# EAGLE board BalanduinoPCB-V1.1 (EAGLE 6.2) (continued)
## Tracks (layer width: path | path; a pad name or v marks a point on that pad's centre or on a via) (continued)
  Top 0.813: C25.2 76.87,35.22 C20.- 76.71,31.41 R24.1 | C4.1 21.68,43.09 21.49,42.9
  Top 1.27: 41.15,56.41 IC8.1 46.25,56.41 47.75,57.91 54.36,57.91 | 41.15,56.41 40.79,56.41 40.79,57.76 40.51,58.04 40.39,58.17 | 54.36,57.91 57.66,57.91 58.67,57.91 59.94,56.64 | C7.2 54.36,57.91 | C8.- 29.11,38.51 28.96,38.35 29.01,38.3 v29.01,38.23 | 38.1,58.55 37.84,58.29 IC4.1 37.84,55.89 37.85,55.88 | C5.2 41.15,56.41
  Top 1.676: 11.05,32.38 10.74,32.08 8.46,32.08 5.11,28.73 MOTOR1.3 2.57,28.73 2.54,28.7 | v89.87,27.1 90.6,27.1 94.74,31.24 96.77,31.24
  Top 2.083: 36.5,58.55 38.1,58.55 40.72,58.55
  Bottom 2.083: 33.78,58.55 36.58,58.55
  other vias: 10.19,31.88 10.19,17.96 11.2,17.96 12.22,17.96 10.19,16.94 10.19,15.93 11.2,16.94 11.2,15.93 12.22,15.93 12.22,16.94 11.2,31.88 12.22,31.88 12.22,32.89 11.2,32.89 10.19,32.89 12.22,33.91 11.2,33.91 10.19,33.91 30.02,37.21 30.02,38.23 31.04,38.23 29.01,37.21 31.04,37.21 32.05,38.23 32.05,37.21 25.96,38.23 25.96,37.21 26.97,37.21 27.99,37.21 27.99,38.23 26.97,38.23 24.94,37.21 24.94,38.23 87.83,28.12 88.85,28.12 89.87,28.12 87.83,27.1 87.83,26.09 88.85,26.09 89.87,26.09 88.85,27.1 89.89,41.99 88.87,41.99 87.86,41.99 89.89,43 89.89,44.02 88.87,43 88.87,44.02 87.86,43 90.88,28.12 90.88,27.1 90.88,26.09 90.91,44.02 90.91,43 90.91,41.99 9.17,33.91 9.17,32.89 9.17,31.88 9.17,17.96 9.17,16.94 9.17,15.93 11.46,40.39 10.44,39.37 10.44,40.39 12.47,39.37 11.46,39.37 12.47,40.39 33.53,25.15 33.53,26.16 38.58,58.09 38.58,59.11 36.55,59.11 37.57,59.11 83.57,18.29 87.86,44.02 24.94,39.24 25.96,39.24 26.97,39.24 27.99,39.24 29.01,39.24 30.02,39.24 31.04,39.24 32.05,39.24 39.6,59.11 40.61,59.11 13.49,40.39 13.49,39.37 9.42,39.37 9.42,40.39 37.57,58.09 39.6,58.09
  pour Top (no thermals): 10.67,28.98 10.67,31.24 6.6,31.24 6.6,39.37 12.7,39.37 12.7,28.98 12.17,28.98 12.17,31.24 11.28,31.24 11.28,28.98
  pour Top (no thermals): 12.78,20.8 12.78,15.44 8.59,15.44 8.59,18.49 10.67,18.49 10.67,20.8 11.28,20.8 11.28,18.54 12.17,18.54 12.17,20.8
  pour Top (no thermals): 0.51,44.2 8.89,44.2 8.89,41.15 32.77,41.15 32.77,36.83 17.02,36.83 17.02,38.86 0.53,38.86
  pour Top (no thermals): 89.41,30.96 89.41,28.7 91.41,28.7 91.41,25.6 87.3,25.6 87.3,30.96 87.91,30.96 87.91,28.7 88.8,28.7 88.8,30.96
  pour Top (no thermals): 87.33,39.14 87.33,44.5 91.47,44.5 91.47,41.4 89.41,41.4 89.41,39.14 88.82,39.14 88.82,41.4 87.91,41.4 87.91,39.14
  pour Bottom (isolate 0.406, no thermals): 35.56,60 100,60 100,0 0,0 0,60 35.05,60 35.05,57.58 13.97,57.58 13.97,38.61 12.65,38.61 12.65,31.37 7.72,31.34 7.72,18.49 12.65,18.49 12.7,2.51 87.22,2.51 87.45,28.7 92.46,28.7 92.46,41.4 87.43,41.4 87.43,45.16 84.43,45.16 84.43,57.58 35.56,57.58
  pour Bottom (isolate 0.406, no thermals): 32,52.07 79.25,52.07 79.25,30.86 84.2,30.86 84.2,24.97 87.63,24.97 87.63,2.29 12.45,2.29 12.45,14.78 15.93,14.78 15.93,20.83 21.34,20.83 21.34,36.83 24.64,40.13 30.99,40.13 32,41.15
  pour Top (no thermals): 17.02,40.64 17.02,43.94 22.1,43.94 22.1,40.64
GPIN0  (via drill 0.4)
  Top 0.254: v13.46,5.59 13.46,4.06 15.75,1.78 44.2,1.78 44.7,2.29 44.7,4.19 40.26,8.64 38.61,8.64 37.59,7.62 34.04,7.62 33.55,8.11 IC2.26 | R34.1 7.58,12.41 OL.1 7.11,12.45 7.11,12.7 4.68,15.13 U1.3
  Bottom 0.254: v13.46,5.59 12.7,5.59 7.37,10.92 OL.1
GPIN1
  Top 0.254: IC2.27 34.05,8.37 34.29,8.13 37.39,8.13 38.4,9.14 40.46,9.14 42.24,7.37 44.02,7.37 45.8,5.59 49.28,5.59 GI1.1
GPIN2
  Top 0.254: IC2.28 34.55,8.89 34.8,8.64 37.16,8.64 38.18,9.65 40.64,9.65 41.4,8.89 44.45,8.89 GI2.1
GPIN3
  Top 0.254: IC2.29 35.05,9.4 35.31,9.14 36.98,9.14 38,10.16 40.89,10.16 41.66,9.4 46.48,9.4 GI3.1
GPIN4
  Top 0.254: IC2.30 35.55,9.92 35.81,9.65 36.83,9.65 37.85,10.67 41.15,10.67 41.91,9.91 52.58,9.91 GI4.1
GPIN5  (via drill 0.4)  (1 unrouted)
  Top 0.254: IC2.31 36.05,12.21 35.92,12.34 v35.53,12.34
  Bottom 0.254: GI5.1 39.37,8.51 35.56,12.32
GPIN6
  Top 0.254: IC2.32 36.55,11.15 36.58,11.18 42.16,11.18 42.67,11.68 42.67,14.99 43.94,16.26 GI6.1
GPIN7
  Top 0.254: IC2.1 38.58,12.22 39.12,11.68 41.91,11.68 42.16,11.94 42.16,14.99 41.15,16 GI7.1
GPOUT0  (via drill 0.4)
  Top 0.254: 4.65,18.26 4.65,18.64 3.73,19.56 1.52,19.56 1.02,19.05 1.02,9.91 1.52,9.4 6.86,9.4 14.99,1.27 44.45,1.27 45.21,2.03 45.21,4.83 v43.43,6.6 | EN.1 6.86,15.75 4.65,17.96 4.65,18.26 | 4.57,18.03 4.69,18.15 U1.4 4.65,18.26 | 37.85,13.72 IC2.4 39.55,13.72 v39.88,14.05
  Bottom 0.254: v43.43,6.6 43.43,7.65 39.88,11.2 v39.88,14.05
GPOUT1
  Top 0.254: IC2.5 38.86,14.22 39.62,14.99 39.62,17.02 GO1.1
GPOUT2  (via drill 0.4)
  Top 0.254: IC2.6 36.82,14.72 36.19,14.1 34.52,14.1 v34.47,14.15
  Bottom 0.254: GO2.1 29.21,5.84 29.97,6.6 31.24,6.6 32,7.37 32,9.14 34.54,11.68 34.54,14.07 v34.47,14.15
GPOUT3  (via drill 0.4)
  Top 0.254: IC2.7 36.56,15.22 36.22,14.88 33.78,14.88 33.78,14.86 v33.6,14.68
  Bottom 0.254: GO3.1 30.73,8.76 34.04,12.06 34.04,12.95 33.27,13.72 33.27,14.35 v33.6,14.68
GPOUT4  (via drill 0.4)
  Top 0.254: IC2.8 37.37,15.72 37.34,15.75 37.34,18.8 37.85,19.3 39.62,19.3 v39.88,19.05 | GO4.1 42.27,24.49 v39.88,22.1
  Bottom 0.254: v39.88,19.05 v39.88,22.1
GPOUT5  (via drill 0.4)
  Top 0.254: IC2.9 36.55,15.85 36.32,15.62 35.81,15.62 v35.81,15.65
  Bottom 0.254: 35.81,15.62 v35.81,15.65 35.81,16.51 35.48,16.84 33.35,16.84 32.26,15.75 30.73,15.75 29.72,16.76 29.72,21.08 31.5,22.86 31.5,23.62 30.99,24.13 GO5.1
GPOUT6  (via drill 0.4)  (1 unrouted)
  Top 0.254: v32.26,18.8 30.4,18.8 29.64,18.03 26.92,18.03 | IC2.10 36.05,18.01 36.58,18.54 v36.58,18.49
  Bottom 0.254: v36.58,18.49 36.53,18.49 36.07,18.03 33.02,18.03 v32.26,18.8
GPOUT7  (via drill 0.4)
  Top 0.254: IC2.11 35.55,18.78 35.81,19.05 35.79,19.08 v35.79,19.13
  Bottom 0.254: v35.79,19.13 35.74,19.13 34.8,20.07 GO7.1
GPX
  Top 0.254: IC2.17 31.7,16.82 GPX.1
INT2  (via drill 0.4)
  Top 0.254: v46.99,22.86 46.99,22.1 47.61,21.48 IC1.42
  Bottom 0.254: v46.99,22.86 42.93,22.86 41.4,24.38 36.83,24.38 35.31,25.91 35.31,30.73 36.83,32.26 41.15,32.26 43.43,34.54 44.7,34.54 47.24,37.08 47.24,41.15 47.75,41.66 54.1,41.66 56.13,43.69 SV2.6
LED  (via drill 0.4)
  Top 0.254: v56.39,26.16 56.39,22.86 v54.86,21.34 | v46.99,19.56 47.24,19.81 48.51,19.81 48.56,19.85 IC1.44 | v67.14,49.02 R10.2
  Bottom 0.254: v56.39,26.16 59.69,29.46 59.69,30.73 62.48,33.53 62.48,41.66 62.74,41.91 64.01,41.91 66.29,44.2 SV2.10 67.14,45.55 v67.14,49.02 | v54.86,21.34 49.53,21.34 47.75,19.56 v46.99,19.56
M1A  (via drill 0.4)  (1 unrouted)
  Top 0.254: v56.64,27.94 56.64,29.56 IC1.25 | v40.64,26.16 40.64,25.15 37.34,21.84 29.21,21.84 27.18,19.81 26.16,19.81 25.15,18.8 25.15,16.87 24.64,16.36 21.62,16.36 20.07,17.91 19.13,17.91 18.44,17.22 18.44,17.12 17.58,16.26 R20.2 16.93,16.17 16.26,15.49 R41.2 | M1A.1 8.13,17.02 8.13,15.24 8.38,14.99 16,14.99 16.51,15.49
  Bottom 0.254: v40.64,26.16 40.64,28.19 41.91,29.46 55.12,29.46 v56.64,27.94
M1B  (via drill 0.4)
  Top 0.254: R21.2 16.76,34.29 17.78,35.31 18.8,35.31 | 18.8,35.31 28.19,35.31 28.7,34.8 32.26,34.8 33.78,36.32 37.34,36.32 42.93,30.73 v45.97,30.73 | IC1.26 55.88,29.6 55.88,27.43 55.37,26.92 54.36,26.92 54.1,26.67 51.56,26.67 49.28,28.96 v49.28,30.73 | v45.97,30.73 46.08,30.73 | M1B.1 18.8,35.31 | R40.2 46.05,30.81 v45.97,30.73
  Bottom 0.254: v49.28,30.73 v45.97,30.73
M1CS  (via drill 0.4)
  Top 0.254: R18.1 21.68,30.06 23.37,31.75 | 23.37,31.75 24.55,31.75 C14.1 | v22.86,32.26 23.37,31.75
  Bottom 0.254: SV4.1 25.65,27.69 22.86,30.48 v22.86,32.26
M1CS_DIS
  Top 0.254: SV4.2 28.45,33.02 27.18,34.29 22.26,34.29 R14.1
M1EN  (via drill 0.4)
  Top 0.254: v58.42,31.24 58.42,29.74 IC1.23 | 24.89,19.81 25.4,20.32 26.92,20.32 28.96,22.35 37.08,22.35 39.88,25.15 39.88,26.92 v39.9,26.92 | 24.89,19.81 24.38,19.3 24.13,19.3 23.88,19.05 | 23.62,18.99 23.62,19.05 23.88,19.05 | R16.2 23.9,19.02 23.88,19.05 | v25.02,19.81 24.89,19.81
  Bottom 0.254: v39.9,26.92 39.9,28.22 41.66,29.97 57.15,29.97 v58.42,31.24 | M1EN.1 25.78,20.57 v25.02,19.81
M2A  (via drill 0.4)
  Top 0.203: R27.2 83.31,43.94
  Top 0.254: v50.55,23.11 48.52,23.11 | 48.51,23.11 48.52,23.11 | 48.52,23.11 IC1.40 | v70.36,26.42 71.37,25.4 73.15,25.4 73.66,25.91 73.66,44.2 75.95,46.48 83.31,46.48 | 83.31,46.48 R27.2 | 83.31,46.48 86.87,46.48 87.54,45.81 R39.2 87.54,45.89 89.15,47.5 89.15,47.75 M2A.1
  Bottom 0.254: v50.55,23.11 51.05,22.61 70.36,22.61 71.37,23.62 71.37,25.65 70.61,26.42 v70.36,26.42
M2B  (via drill 0.4)
  Top 0.203: 77.22,21.34 80.52,21.34 82.55,23.37 83.57,23.37 | 83.4,23.62 R38.2 | R38.2 83.48,23.46 | 83.06,24.89 R28.2 83.15,24.8 83.31,24.64 83.31,23.62 83.57,23.37 | R38.2 83.57,23.37
  Top 0.254: 77.22,21.34 v75.18,23.37 | IC1.41 50.11,22.28 50.29,22.1 v50.29,22.07 | 83.57,23.37 84.58,23.37 M2B.1
  Bottom 0.254: v75.18,23.37 73.66,23.37 72.39,22.1 50.29,22.1 v50.29,22.07
M2CS
  Top 0.254: C27.1 77.22,28.28 R25.1 77.38,27.01 SV5.1
M2CS_DIS
  Top 0.254: SV5.2 79.25,23.37 80.77,24.89 R29.1
M2EN  (via drill 0.4)
  Top 0.254: R23.2 75.18,42.93 74.68,42.42 74.68,32 v75.18,31.5 | IC1.24 57.56,31.9 57.91,32.26 64.01,32.26 v66.8,29.46
  Bottom 0.254: v66.8,29.46 72.14,29.46 | 72.14,29.46 73.15,29.46 v75.18,31.5 | M2EN.1 72.39,29.72 72.14,29.46
MAX_INT  (via drill 0.4)  (1 unrouted)
  Top 0.254: IC1.21 61.11,27.08 61.47,27.43 64.01,27.43 v64.26,27.18 | 28.96,17.27 R5.1 28.96,17.02 29.21,17.02 29.72,16.51 29.72,16 30.5,15.22 IC2.18 32.75,15.22 33.27,15.75
  Bottom 0.254: v64.26,27.18 64.52,27.43 79.25,27.43 80.52,26.16 80.52,8.89 77.22,5.59 43.31,5.59 42.16,6.73 42.16,8.2 35.05,15.32 35.05,16 34.67,16.38 33.66,16.38 33.27,16 33.27,15.7 v33.22,15.65
MAX_SS  (via drill 0.4)
  Top 0.254: v64.26,28.45 61.21,28.45 | 61.21,28.45 60.71,27.94 60.2,27.94 60.16,27.9 IC1.22 | 61.21,28.45 61.21,29.72 R37.2 | IC2.14 34.05,15.81 v34.24,15.62
  Bottom 0.254: v64.26,28.45 79.76,28.45 81.03,27.18 81.03,8.64 77.47,5.08 42.67,5.08 41.66,6.1 41.66,8 34.24,15.42 v34.24,15.62
MISO
  Top 0.254: IC2.15 33.55,19.83 34.54,20.83 43.43,20.83 48.51,15.75 48.51,14.22 X3.1 51.16,15.85 IC1.2
MOSI  (via drill 0.4)
  Top 0.254: IC1.1 50.36,16.57 v49.4,15.62 43.69,21.34 34.29,21.34 33.05,20.09 IC2.16
  Bottom 0.254: X3.4 47.5,12.45 50.29,12.45 51.05,13.21 51.05,13.97 v49.4,15.62
MOUT1A  (via drill 0.4)
  Top 0.254: IC5.2 10.24,19.96 10.24,22.86 | 10.24,23.01 11.82,23.01 IC5.S2 11.82,22.86 | IC5.8 13.21,22.86
  Top 1.676: 10.24,23.65 10.24,22.86 | 2.54,23.62 2.54,23.65 MOTOR1.1 9.88,23.65 9.91,23.62
  other vias: 13.06,23.9 13.06,22.89 13.06,21.87 12.04,21.87 11.02,21.87 10.01,21.87 8.99,21.87 8.99,22.89 8.99,23.9 10.01,23.9 11.02,23.9 12.04,23.9 12.04,22.89 11.02,22.89 10.01,22.89 14.76,17.96 13.74,17.96 14.76,16.94 14.76,15.93 13.74,15.93 13.74,16.94
  pour Top (no thermals): 8.38,24.49 13.54,24.49 13.54,21.34 8.38,21.34
  pour Bottom (no thermals): 8.38,24.49 13.54,24.49 13.54,21.34 8.38,21.34
  pour Top (no thermals): 15.27,20.8 15.27,15.44 13.18,15.44 13.18,20.8 13.28,20.8 13.28,18.8 14.17,18.8 14.17,20.8
  pour Bottom (no thermals): 13.28,19.1 13.28,15.44 15.27,15.47 15.27,20.83 13.56,20.8 13.56,21.84 8.41,21.84 8.41,19.1
MOUT1B  (via drill 0.4)
  Top 0.254: IC5.29 13.23,29.82 13.23,26.42 | 12.19,26.42 11.82,26.42 IC5.S3 11.82,27.1 | IC5.35 10.24,29.82 10.24,27.1
  Top 1.676: 10.24,26.16 10.24,27.1 | 2.54,26.16 2.54,26.19 MOTOR1.2 9.62,26.19 9.65,26.16
  other vias: 13.06,25.86 13.06,26.87 13.06,27.89 12.04,27.89 11.02,27.89 10.01,27.89 8.99,27.89 8.99,26.87 8.99,25.86 10.01,25.86 10.01,26.87 11.02,26.87 12.04,26.87 12.04,25.86 11.02,25.86 13.69,33.91 14.71,33.91 14.71,32.89 14.71,31.88 13.69,31.88 13.69,32.89
  pour Top (no thermals): 8.38,28.45 13.54,28.45 13.54,25.3 8.38,25.3
  pour Bottom (no thermals): 8.38,28.45 13.54,28.45 13.54,25.3 8.38,25.3
  pour Top (no thermals): 13.18,28.98 13.18,34.47 15.27,34.47 15.27,28.98 14.17,28.98 14.17,30.99 13.28,30.99 13.28,28.98
  pour Bottom (no thermals): 13.28,30.68 13.28,34.47 15.09,34.47 15.09,28.98 13.56,28.98 13.56,27.94 8.41,27.94 8.41,30.68
MOUT2A  (via drill 0.4)
  Top 0.254: IC6.8 86.87,39.98 86.87,36.58 88.39,36.58 88.39,36.83 88.33,36.77 88.33,36.7 | IC6.2 89.86,36.77 89.79,36.7 88.33,36.7 | 88.33,36.7 IC6.S2
  Top 1.676: 89.86,36.77 89.86,36.35 MOTOR2.1 97.54,36.35 97.54,36.32
  other vias: 87.02,36.04 87.02,37.06 88.04,36.04 89.05,36.04 90.07,36.04 91.08,36.04 87.02,38.07 88.04,38.07 89.05,38.07 90.07,38.07 91.08,38.07 91.08,37.06 90.07,37.06 89.05,37.06 88.04,37.06 85.29,41.83 86.31,41.83 86.31,42.85 86.31,43.87 85.29,43.87 85.29,42.85
  pour Top (no thermals): 86.51,38.61 91.67,38.61 91.67,35.46 86.51,35.46
  pour Bottom (no thermals): 86.51,38.61 91.67,38.61 91.67,35.46 86.51,35.46
  pour Top (no thermals): 84.81,39.24 84.81,44.5 86.89,44.5 86.89,39.14 86.82,39.14 86.82,41.15 85.9,41.15 85.9,39.24
  pour Bottom (no thermals): 86.82,40.72 86.82,44.5 84.81,44.5 84.81,39.24 86.51,39.24 86.51,35.56 91.67,35.56 91.67,40.72
MOUT2B  (via drill 0.4)
  Top 0.254: IC6.29 86.86,33.26 | 87.12,33.53 88.21,33.53 IC6.S3 88.31,33.53 89.66,33.53 89.86,33.33 IC6.35
  Top 1.676: 89.86,33.33 89.86,33.81 MOTOR2.2 97.54,33.81 97.54,33.78
  other vias: 87.02,34.09 88.04,34.09 89.05,34.09 90.07,34.09 91.08,34.09 87.02,33.07 87.02,32.05 88.04,32.05 89.05,32.05 90.07,32.05 91.08,32.05 91.08,33.07 90.07,33.07 89.05,33.07 88.04,33.07 86.33,28.17 85.32,28.17 85.32,27.15 85.32,26.14 86.33,26.14 86.33,27.15
  pour Top (no thermals): 86.51,34.65 91.67,34.65 91.67,31.5 86.51,31.5
  pour Bottom (no thermals): 86.51,34.65 91.67,34.65 91.67,31.5 86.51,31.5
  pour Top (no thermals): 86.92,30.96 86.92,25.6 84.81,25.6 84.81,30.86 85.9,30.86 85.9,28.85 86.82,28.85 86.82,30.96
  pour Bottom (no thermals): 86.79,29.51 86.79,25.6 84.81,25.6 84.81,30.86 86.51,30.86 86.51,34.54 91.67,34.54 91.67,29.51
N$1
  Top 0.254: C3.2 61.98,10.92 SJ1.1
N$2
  Top 0.254: IC1.8 55.96,8.31 56.9,7.37 C2.1 56.81,3.47 56.64,3.3 Q1.1
N$3
  Top 0.254: IC1.7 55.16,7.42 C1.2 55.21,6.69 51.82,3.3 Q1.2
N$4
  Top 0.61: Q4.3 71.37,50.02 D2.A 72.92,51.56 77.22,51.56 77.88,50.9 BUZZER.-
N$5
  Top 0.254: R11.1 72.22,42 JP1.2
N$6
  Top 0.254: X4.2 81.79,15.75 73.66,15.75 73.15,16.26 70.87,16.26 70.61,16 R33.1
N$7
  Top 0.254: LED.A R10.1
N$9
  Top 0.254: R2.1 PWR.A
N$10
  Top 0.254: X4.3 82.63,12.87 80.26,15.24 72.22,15.24 R32.1
N$11
  Top 0.254: IC9.7 71.05,13.19 R33.2
N$12
  Top 0.61: 27.12,5.02 27.18,5.08 26.92,5.08 26.67,5.33 F1.2 27,5.2 SJ2.2
N$14  (1 unrouted)
  Top 0.254: 28.83,15.62 28.7,15.75 | IC2.20 30.74,14.22 29.72,15.24 29.3,15.24 R7.2
N$16
  Top 0.254: IC2.21 29.29,13.72 R6.2
N$17
  Top 0.254: X5.3 18.67,12.9 18.67,13.84 19.61,14.78 26.53,14.78 R6.1
N$18
  Top 0.254: R7.1 27.09,15.91 | R7.1 27.05,15.75 26.57,15.27 18.06,15.27 16.76,13.97 16.76,12.93 X5.2 | R7.1 27.18,15.75
N$19
  Top 0.254: IC2.25 33.05,7.85 34.04,6.86 | 34.04,6.86 34.04,5.84 36.58,3.3 Q2.2 | 34.04,6.86 34.29,6.6 C17.2
N$20
  Top 0.254: 31.34,12.22 31.35,12.22 IC2.24 32.33,12.22 32.35,12.21 32.35,6.86 C16.2 32.6,3.47 32.77,3.3 Q2.1
N$21  (1 unrouted)
  Top 0.254: IC3.12 36.67,27.85 37.59,26.92
N$22
  Top 0.254: IC3.20 34.56,33.78 | 34.56,33.78 34.56,33.93 | C22.1 34.56,33.78
N$23
  Top 0.254: IC3.10 34.06,26.99 C23.2
N$24
  Top 0.254: R23.1 R13.1 78.49,41.4 81.28,38.61 | IC6.21 82.86,31.27 82.63,31.5 82.04,31.5 81.28,32.26 81.28,38.61 | IC6.16 82.86,38.91 82.55,38.61 81.28,38.61
N$25
  Top 0.254: R25.2 79.08,30.23 | 79.08,30.23 R24.2 | IC6.19 79.19,30.12 79.08,30.23
N$26  (1 unrouted)
  Top 0.254: IC5.16 17.22,21.03 17.53,21.34 18.29,21.34 18.54,21.59 | 18.54,21.59 18.54,27.94 18.03,28.45 17.53,28.45 17.22,28.75 IC5.21 | 18.54,21.59 20.07,21.59 20.57,21.08 20.57,19.56 22.35,17.78 R15.1 23.39,17.77 R16.1 | 22.3,17.88 22,17.88 22.1,17.78
N$27
  Top 0.254: R11.2 70.52,46.57 70.36,46.74 70.37,46.75 Q4.1
N$29
  Top 0.254: IC5.19 18.94,29.82 20.32,28.45 21.84,28.45 | 21.84,28.45 24.13,28.45 R17.2 | R18.2 21.76,28.36 21.84,28.45
N$30
  Top 0.254: IC5.20 17.72,30.93 18.03,31.24 19.22,31.24 R12.1 20.57,30.9 R14.2 21.34,31.75
N$31
  Top 0.254: IC5.22 16.72,31.62 R21.1
N$32
  Top 0.254: IC5.15 16.72,18.94 17.42,18.24 17.53,18.24 | 17.53,18.24 17.66,18.24 | R20.1 17.58,18.19 17.53,18.24
N$33
  Top 0.254: IC5.17 17.72,18.96 17.93,18.74 18.73,18.74 18.73,19.53 R19.1
N$34
  Top 0.254: IC6.22 83.36,26.71 83.06,26.42 R28.1
N$35
  Top 0.254: IC6.15 83.36,42.29 R27.1
N$36
  Top 0.254: IC6.17 82.36,41.51 R26.1
N$37
  Top 0.254: IC6.20 82.36,28.09 R29.2 80.77,26.49 81.61,25.65 83.85,25.65 84.66,24.84 87.51,24.84 R22.1
N$40
  Top 0.61: F2.1 85.67,14.35 X4.1
N$41
  Top 0.254: IC9.15 71.7,6.87 R8.2
N$42
  Top 0.254: IC9.2 73.59,9.83 74.42,10.67 75.1,10.67 R9.2
N$43
  Top 0.254: IC9.6 71.7,13.19 R32.2
N$45
  Top 0.254: IC9.8 IC9.9 68.66,11.13 C30.2
N$48
  Top 0.254: RX.A 65.53,13.21 64.77,13.97 64.77,17.53 65.28,18.03 R3.1
N$49
  Top 0.254: R4.1 66.21,14.93 TX.A
PWM1A  (via drill 0.4)
  Top 0.254: v32.51,21.08 32.26,21.08 32,21.34 29.41,21.34 27.38,19.3 26.42,19.3 25.65,18.54 25.65,16.61 24.89,15.85 19.96,15.85 19.61,16.2 PWM1A.1 | IC1.14 61.33,21.48 62.99,19.81 v63.5,19.81 | 20.07,18.54 19.88,18.54 R19.2 20.36,18.76 20.83,18.29 v20.83,18.19
  Bottom 0.254: v32.51,21.08 36.07,21.08 37.34,19.81 37.34,16 38.35,14.99 40.13,14.99 41.15,13.97 41.15,11.18 42.93,9.4 61.21,9.4 63.5,11.68 v63.5,19.81 | PWM1A.1 19.61,16.97 v20.83,18.19
PWM1B  (via drill 0.4)
  Top 0.254: v74.17,22.48 74.17,43.94 75.18,44.96 PWM1B.1 80.52,44.96 81.53,43.94 R26.2 | IC1.13 58.83,20.68 v58.42,21.08
  Bottom 0.254: v58.42,21.08 58.93,21.59 73.28,21.59 v74.17,22.48
PWM2A  (via drill 0.4)
  Top 0.254: IC1.16 60.19,23.11 61.47,23.11 62.23,22.35 67.31,22.35 v68.33,23.37 | v68.33,25.91 69.09,26.67 69.09,40.89 67.56,42.42 62.48,42.42 61.21,43.69 SV2.8
  Bottom 0.254: v68.33,23.37 v68.33,25.91
PWM2B  (via drill 0.4)
  Top 0.254: IC1.15 61.54,22.28 61.98,21.84 68.83,21.84 70.1,23.11 70.1,23.62 69.6,24.13 67.56,24.13 v67.06,23.62 | v67.06,25.91 68.58,27.43 68.58,40.64 67.56,41.66 60.71,41.66 58.67,43.69 SV2.7
  Bottom 0.254: v67.06,23.62 v67.06,25.91
RESET  (via drill 0.4)
  Top 0.254: SJ1.2 61.06,11.84 v59.94,12.95 | 55.63,48.77 50.55,48.77 48.51,46.74 SV2.3 48.51,43.94 46.74,42.16 45.97,42.16 44.7,40.89 v44.7,35.81 | 55.63,48.77 58.17,48.77 59.78,50.38 S1.B2 | 55.66,51.52 D3.A 55.71,51.31 R1.1 55.63,49.78 55.63,48.77 | 55.66,51.52 55.63,51.56 | 55.66,51.52 55.68,51.52 | IC2.12 35.05,19.55 35.36,19.86 42.98,19.86 45.85,16.99 45.85,15.62 X3.5 | IC1.4 v52.76,19.71 | 52.76,19.81 v52.76,19.71 | v52.76,19.71
  Bottom 0.254: v59.94,12.95 59.94,11.68 58.93,10.67 57.15,10.67 55.63,12.19 55.63,17.02 52.83,19.81 52.83,19.79 v52.76,19.71 52.73,19.71 52.7,19.68 50.04,19.68 47.68,17.33 | v44.7,35.81 43.94,35.81 40.89,32.77 36.32,32.77 34.54,30.99 34.54,25.4 36.07,23.88 41.15,23.88 47.68,17.34 47.68,17.33 | 44.2,13.97 X3.5 44.07,13.72 47.68,17.33
RTS
  Top 0.254: IC9.16 72.35,8.42 73.66,7.11 73.66,4.57 70.61,1.52 64.77,1.52 62.23,4.06 62.23,6.77 C3.1
RXD  (via drill 0.4)
  Top 0.254: 56.85,18.08 56.64,18.29 | IC1.9 56.85,18.08 | 56.85,18.08 56.9,18.03 56.77,17.91 56.77,16.64 59.18,14.22 60.96,14.22 63.25,11.94 v63.25,4.32 63.25,3.81 64.77,2.29 70.36,2.29 71.88,3.81 R8.1 72.3,4.99
  Bottom 0.254: v63.25,4.32 62.99,4.57 30.23,4.57 29.97,4.32 28.19,4.32 27.69,4.83 27.69,6.35 29.46,8.13 29.46,13.72 24.08,19.1 24.08,22.35 27.13,25.4 29.97,25.4 32,27.43 32,30.73 35.56,34.29 39.88,34.29 42.93,37.34 43.94,37.34 44.7,38.1 44.7,40.89 45.97,42.16 49.53,42.16 51.05,43.69 SV2.4
RXLED
  Top 0.254: IC9.11 69.14,9.83 68.58,9.27 68.58,4.32 67.56,3.3 66.29,3.3 64.77,4.83 64.77,11.18 65.79,12.19 67.82,12.19 68.07,12.45 68.07,13.21 RX.C
SCK  (via drill 0.4)
  Top 0.254: IC2.13 34.54,20.07 34.8,20.32 43.18,20.32 46.48,17.02 X3.3 | v51.97,16.59 51.97,18.06 IC1.3
  Bottom 0.254: v51.97,16.59 49.1,16.59 X3.3
SCL  (via drill 0.4)
  Top 0.254: IC3.23 33.02,34.04 34.29,35.31 36.83,35.31 42.42,29.72 v42.42,28.7 42.82,28.7 44.04,27.48 R30.1 | IC1.19 61.04,25.48 v61.98,26.42
  Bottom 0.254: SV1.10 66.29,32.26 62.99,28.96 62.99,27.43 v61.98,26.42 61.98,25.4 60.45,23.88 53.09,23.88 50.55,26.42 44.7,26.42 v42.42,28.7
SDA  (via drill 0.4)
  Top 0.254: IC3.24 32.52,34.29 34.04,35.81 37.08,35.81 43.94,28.96 v43.94,28.7 45.3,28.7 | v58.17,25.65 58.8,26.29 60.14,26.29 IC1.20
  Top 0.406: 45.3,28.7 45.3,28.62 R31.1
  Bottom 0.254: SV1.9 63.75,31.24 v58.17,25.65 56.9,24.38 54.1,24.38 51.05,27.43 45.21,27.43 v43.94,28.7
TXD  (via drill 0.4)
  Top 0.254: v57.79,13.08 57.79,11.56 60.96,8.38 60.96,5.59 61.47,5.08 v61.47,3.81 64.26,1.02 71.37,1.02 75.18,4.83 R9.1 | IC1.10 57.56,20.02 v57.53,20.04
  Bottom 0.254: v61.47,3.81 27.94,3.81 27.18,4.57 27.18,6.6 28.96,8.38 28.96,13.46 23.62,18.8 23.62,22.61 26.92,25.91 29.72,25.91 31.5,27.69 31.5,30.99 35.31,34.8 39.62,34.8 41.91,37.08 41.91,41.15 43.43,42.67 49.28,42.67 49.78,43.18 49.78,46.23 50.55,46.99 52.58,46.99 53.59,45.97 SV2.5 | v57.79,13.08 57.79,19.94 57.66,20.07 57.63,20.04 v57.53,20.04
TXLED
  Top 0.254: TX.C 68.33,14.73 68.58,14.48 73.66,14.48 73.91,14.22 73.91,13.45 IC9.5
VBAT  (via drill 0.4)
  Top 0.254: v43.69,32.13 37.72,38.1 36.32,38.1 34.29,40.13 34.29,42.93 33.53,43.69 32.51,43.69 32,44.2 26.67,44.2 25.57,43.09 R35.1 R36.2 25.4,41.91 25.31,42 C34.2 | IC1.32 51.16,31.14 v51.05,31.24
  Bottom 0.254: v43.69,32.13 43.94,32.13 44.45,32.64 46.86,32.64 48.51,34.29 50.8,34.29 51.56,33.53 51.56,31.75 v51.05,31.24
VBUS  (via drill 0.4)
  Top 0.254: IC9.10 69.03,10.48 67.44,8.89 67.31,8.89
  Top 0.406: v67.31,10.16 67.31,9.4 | 67.31,9.4 67.31,8.89 C12.1 | C13.2 67.22,9.49 67.31,9.4 | F2.2 93.93,17.15 D1.A
  Top 0.61: R4.2 67.91,17.27 | 67.91,17.27 67.91,17.95 67.82,18.03 R3.2 68.07,18.03 | 67.91,17.27 68.03,17.14 v69.21,17.14 F2.2
  Bottom 0.406: v69.21,17.14 69.21,12.06 v67.31,10.16
VBUS_HOST
  Top 0.61: X5.1 14.2,6.86 | 14.2,6.86 10.92,6.86 7.39,10.39 2.9,10.39 2.08,11.2 2.08,11.63 2.03,11.68 C19.1 | U1.1 2.78,14.77 2.02,14.01 C18.1 2.02,11.76 C19.1 | 2.03,11.75 C19.1 | SJ2.1 17.78,3.3 14.22,6.86 14.2,6.86
VCC  (via drill 0.4)
  Top 0.254: IC6.13 84.36,34.94 | IC6.24 84.36,34.14 | IC5.24 15.72,27.43 14.99,27.43 | IC5.13 15.72,22.35 16.15,22.35 v16.15,22.38
  Top 0.61: C11.+ 21.59,25.4 | 21.59,25.4 v19.56,25.4 | v19.56,25.4 v19.56,26.42 | v19.56,25.4 v19.56,24.38 | C20.+ v80.26,35.05 | v80.26,35.05 v80.26,36.07 | v80.26,35.05 v80.26,34.04 | C32.1 21.5,25.31 21.59,25.4
  Top 0.813: 17.2,25.4 v17.17,25.43 | 82.93,34.54 v82.96,34.57 | C25.1 78.57,35.22 C20.+
  other vias: 15.14,27.46 17.17,27.46 15.14,26.44 15.14,25.43 15.14,24.41 15.14,23.39 16.15,26.44 17.17,26.44 16.15,25.43 16.15,24.41 17.17,24.41 16.15,23.39 17.17,23.39 15.14,22.38 17.17,22.38 82.96,32.54 82.96,33.55 83.97,32.54 83.97,33.55 83.97,34.57 84.99,32.54 84.99,33.55 84.99,34.57 84.99,35.59 84.99,36.6 84.99,37.62 83.97,37.62 83.97,35.59 83.97,36.6 82.96,37.62 82.96,36.6 82.96,35.59 16.15,27.46 19.56,56.13 19.56,55.12 19.56,54.1 20.57,54.1 21.59,54.1 22.61,54.1 22.61,55.12 21.59,55.12 20.57,55.12 20.57,56.13 21.59,56.13 22.61,56.13 24.38,46.99 25.4,46.99 26.42,46.99 27.43,46.99 27.43,48.01 26.42,48.01 25.4,48.01 24.38,48.01 23.62,54.1 23.62,55.12 23.62,56.13 23.37,48.01 23.37,46.99 24.64,56.13 25.65,56.13 26.67,56.13 27.69,56.13 28.7,56.13 29.72,56.13 24.64,55.12 24.64,54.1 25.65,54.1 26.67,54.1 27.69,54.1 28.7,54.1 29.72,55.12 28.7,55.12 27.69,55.12 26.67,55.12 25.65,55.12 23.37,49.02 24.38,49.02 25.4,49.02 26.42,49.02 27.43,49.02
  pour Bottom (isolate 0.406, no thermals): 14.35,21.59 14.35,28.19 15.75,28.19 15.75,49.28 18.8,49.28 18.8,56.95 83.82,56.95 83.82,38.25 85.7,38.25 85.7,31.9 79.88,31.9 79.86,52.68 30.53,52.68 30.53,41.15 23.88,41.15 20.07,37.34 20.07,21.59
  pour Top (no thermals): 14.35,27.94 17.88,27.94 17.88,21.84 14.35,21.84
  pour Top (no thermals): 82.22,38.13 85.7,38.13 85.7,32.08 82.22,32.08
  pour Top (isolate 0.406, no thermals): 18.8,46.48 18.8,56.9 30.48,56.9 30.48,46.48
VCC_INT
  Top 0.254: 26.34,51.79 26.44,51.79 S4.1
  Top 0.406: 33.28,56.38 IC4.3 33.15,56.23 33.15,55.63 33.15,55.57
  Top 0.813: 25.44,44.83 R35.2 | R35.2 C4.2 | C8.+ 26.11,45.41 25.49,44.79 | 25.49,44.79 25.4,44.7 | R35.2 25.49,44.79
  Top 1.27: C8.+ 29.11,51.82 | 26.34,51.79 29.08,51.79 29.08,51.82 29.11,51.82 | 29.11,51.82 29.34,51.82 33.15,55.63
VDD
  Top 1.93: SV3.1 10.16,48.01 Q3.4
  pour Top (no thermals): 0.51,44.96 0.51,49.28 16.26,49.28 16.26,42.16 9.91,42.16 9.91,44.96
(copper drawn outside any net)
  shapes: Bottom area x2

## Text on the board
tPlace: Balanduino | V1.2
bPlace: Balanduino
tNames: OFF | ON | RST | RX | TX | ~ | ~ | ~ | ~ | 3.3V | GND | RST | 0 | 1 | 2 | 3 | 4 | 5 | 6 | WHT | +5V | GND | A0 | A1 | A2 | A3 | A4 | AREF | SDA | SCL | RED | IC3 | RED | WHT
bNames: + | - | M2A | E1B | M2B | E1A | GND | +3V3 | +3V3 | GND | E2A | M1B | E2B | M1A